# EasyEDA Pro project ProProject_IMUSensorNodes202312.epro, board 6_6_拼板20240123（带编号） (continued)
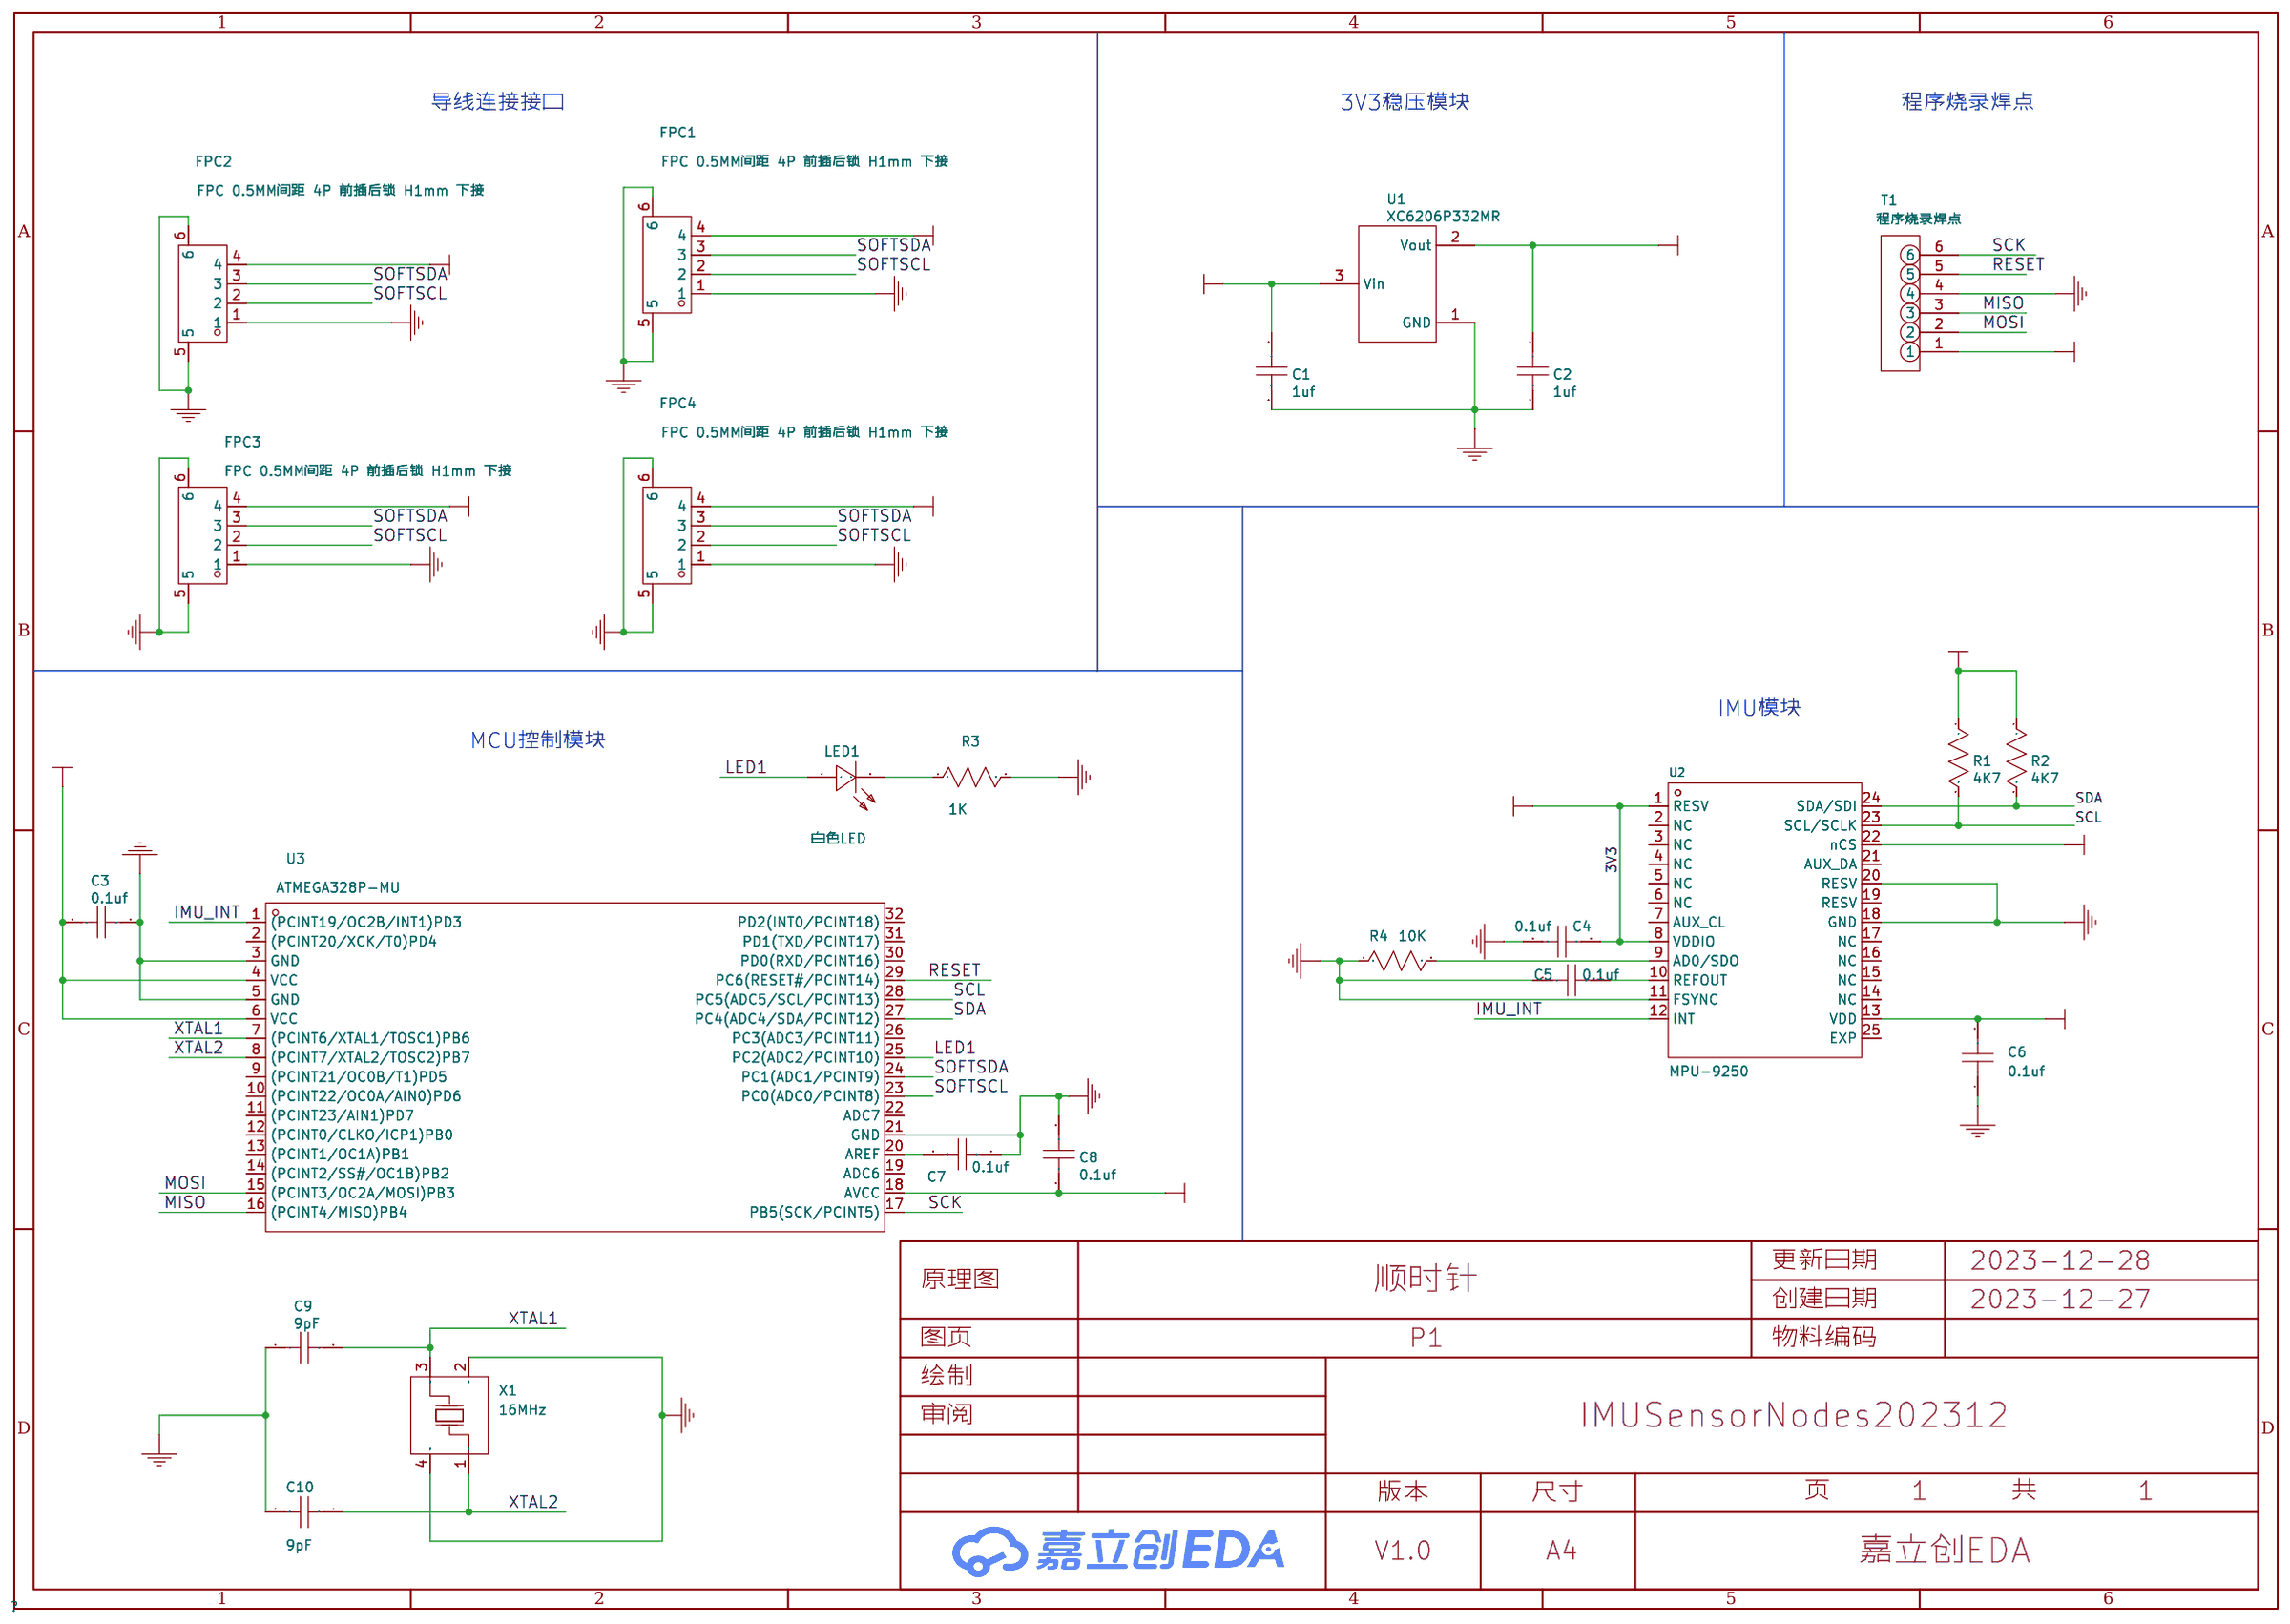
[diagram p0: schematic sheet]
## Routing (per net, layer and track width the routed paths; a pad name or vN(x,y) marks a point on that pad's centre or on a via; arc(x,y) is an arc through that point) (continued)
  Bottom Layer w0.254: 16.46,51.58 16.27,51.58 16.16,51.46 14.64,51.46 14.25,51.08 14.25,45.11 15,44.36 Designator#902.27 ; 16.46,51.58 Designator#418.2 ; 16.46,51.58 Designator#890.24 ; 43.76,10.43 43.58,10.43 43.47,10.32 41.94,10.32 41.56,9.94 41.56,3.97 42.31,3.22 Designator#838.27 ; 43.76,10.43 Designator#326.24 ; 43.76,10.43 Designator#373.2 ; Designator#830.24 71.07,37.86 ; 71.07,37.86 70.88,37.86 70.77,37.75 69.25,37.75 68.87,37.37 68.87,31.4 69.62,30.65 Designator#801.27 ; 71.07,37.86 Designator#341.2 ; Designator#820.27 15,71.8 14.25,72.55 14.25,78.52 14.64,78.9 16.16,78.9 16.27,79.01 16.46,79.01 ; 43.76,24.14 43.58,24.14 43.47,24.03 41.94,24.03 41.56,23.65 41.56,17.68 42.31,16.93 Designator#885.27 ; 43.76,24.14 Designator#813.24 ; 43.76,24.14 Designator#356.2 ; Designator#322.27 42.31,44.36 41.56,45.11 41.56,51.08 41.94,51.46 43.47,51.46 43.58,51.58 43.76,51.58 ; Designator#323.24 16.46,10.43 ; 16.46,10.43 16.27,10.43 16.16,10.32 14.64,10.32 14.25,9.94 14.25,3.97 15,3.22 Designator#913.27 ; 16.46,10.43 Designator#367.2 ; 43.76,79.01 43.58,79.01 43.47,78.9 41.94,78.9 41.56,78.52 41.56,72.55 42.31,71.8 Designator#889.27 ; 43.76,79.01 Designator#394.2 ; 43.76,79.01 Designator#880.24 ; Designator#918.24 71.07,79.01 ; 71.07,79.01 70.88,79.01 70.77,78.9 69.25,78.9 68.87,78.52 68.87,72.55 69.62,71.8 Designator#810.27 ; 71.07,79.01 Designator#344.2 ; Designator#883.24 71.07,24.14 ; 71.07,24.14 70.88,24.14 70.77,24.03 69.25,24.03 68.87,23.65 68.87,17.68 69.62,16.93 Designator#895.27 ; 71.07,24.14 Designator#362.2 ; 16.46,79.01 Designator#886.24 ; 16.46,79.01 Designator#388.2 ; 16.46,37.86 16.27,37.86 16.16,37.75 14.64,37.75 14.25,37.37 14.25,31.4 15,30.65 Designator#822.27 ; 16.46,37.86 Designator#923.24 ; 16.46,37.86 Designator#329.2 ; 43.76,65.29 43.58,65.29 43.47,65.18 41.94,65.18 41.56,64.8 41.56,58.83 42.31,58.08 Designator#324.27 ; 43.76,65.29 Designator#314.24 ; 43.76,65.29 Designator#406.2 ; Designator#897.24 43.76,51.58 ; 43.76,51.58 Designator#424.2 ; 16.46,24.14 16.27,24.14 16.16,24.03 14.64,24.03 14.25,23.65 14.25,17.68 15,16.93 Designator#904.27 ; 16.46,24.14 Designator#836.24 ; 16.46,24.14 Designator#350.2 ; 71.07,51.58 70.88,51.58 70.77,51.46 69.25,51.46 68.87,51.08 68.87,45.11 69.62,44.36 Designator#906.27 ; 71.07,51.58 Designator#430.2 ; 71.07,51.58 Designator#912.24 ; Designator#835.27 15,58.08 14.25,58.83 14.25,64.8 14.64,65.18 16.16,65.18 16.27,65.29 16.46,65.29 ; 16.46,65.29 Designator#400.2 ; 16.46,65.29 Designator#915.24 ; 71.07,65.29 Designator#412.2 ; 71.07,65.29 Designator#881.24 ; 71.07,65.29 70.88,65.29 70.77,65.18 69.25,65.18 68.87,64.8 68.87,58.83 69.62,58.08 Designator#809.27 ; Designator#882.24 43.76,37.86 ; 43.76,37.86 Designator#335.2 ; 43.76,37.86 43.58,37.86 43.47,37.75 41.94,37.75 41.56,37.37 41.56,31.4 42.31,30.65 Designator#839.27 ; Designator#826.24 71.07,10.43 ; 71.07,10.43 Designator#379.2 ; 71.07,10.43 70.88,10.43 70.77,10.32 69.25,10.32 68.87,9.94 68.87,3.97 69.62,3.22 Designator#910.27
SOFTSCL: length 811.1
  Top Layer w0.2: 61.88,64.93 61.81,64.99 58.52,64.99 58.2,64.67 58.2,63.78 56.55,62.13 56.55,61.24 57.18,60.61 Designator#241.3 ; Designator#214.2 19.97,50.55 19.43,51.08 18.57,51.08 17.94,50.45 17.94,47.65 17.68,47.4 16.92,47.4 Designator#283.2 ; 34.57,23.78 34.51,23.84 31.21,23.84 30.89,23.52 30.89,22.64 29.24,20.98 29.24,20.09 29.87,19.46 Designator#284.3 ; Designator#237.2 71.53,61.12 72.29,61.12 72.55,61.37 72.55,64.16 73.18,64.8 74.04,64.8 74.58,64.26 Designator#239.2 ; 61.88,51.21 61.81,51.28 58.52,51.28 58.2,50.96 58.2,50.07 56.55,48.42 56.55,47.53 57.18,46.9 Designator#164.3 ; 7.27,64.93 7.2,64.99 3.91,64.99 3.59,64.67 3.59,63.78 1.94,62.13 1.94,61.24 2.57,60.61 Designator#100.3 ; Designator#167.3 29.87,60.61 29.24,61.24 29.24,62.13 30.89,63.78 30.89,64.67 31.21,64.99 34.51,64.99 34.57,64.93 ; Designator#156.2 16.92,6.25 17.68,6.25 17.94,6.51 17.94,9.3 18.57,9.94 19.43,9.94 19.97,9.4 Designator#301.2 ; 34.57,51.21 34.51,51.28 31.21,51.28 30.89,50.96 30.89,50.07 29.24,48.42 29.24,47.53 29.87,46.9 Designator#173.3 ; Designator#2.3 2.57,19.46 1.94,20.09 1.94,20.98 3.59,22.64 3.59,23.52 3.91,23.84 7.2,23.84 7.27,23.78 ; Designator#282.3 2.57,46.9 1.94,47.53 1.94,48.42 3.59,50.07 3.59,50.96 3.91,51.28 7.2,51.28 7.27,51.21 ; Designator#217.2 71.53,19.97 72.29,19.97 72.55,20.22 72.55,23.02 73.18,23.65 74.04,23.65 74.58,23.11 Designator#238.2 ; Designator#221.2 47.27,23.11 46.73,23.65 45.88,23.65 45.24,23.02 45.24,20.22 44.99,19.97 44.22,19.97 Designator#312.2 ; Designator#98.2 71.53,6.25 72.29,6.25 72.55,6.51 72.55,9.3 73.18,9.94 74.04,9.94 74.58,9.4 Designator#6.2 ; 34.57,37.49 34.51,37.56 31.21,37.56 30.89,37.24 30.89,36.35 29.24,34.7 29.24,33.81 29.87,33.18 Designator#158.3 ; Designator#87.3 57.18,33.18 56.55,33.81 56.55,34.7 58.2,36.35 58.2,37.24 58.52,37.56 61.81,37.56 61.88,37.49 ; Designator#15.2 19.97,36.83 19.43,37.37 18.57,37.37 17.94,36.73 17.94,33.94 17.68,33.68 16.92,33.68 Designator#94.2 ; 34.57,78.64 34.51,78.71 31.21,78.71 30.89,78.39 30.89,77.5 29.24,75.85 29.24,74.96 29.87,74.33 Designator#220.3 ; Designator#225.2 19.97,64.26 19.43,64.8 18.57,64.8 17.94,64.16 17.94,61.37 17.68,61.12 16.92,61.12 Designator#3.2 ; Designator#168.3 29.87,5.75 29.24,6.38 29.24,7.27 30.89,8.92 30.89,9.81 31.21,10.13 34.51,10.13 34.57,10.06 ; Designator#18.2 74.58,77.98 74.04,78.52 73.18,78.52 72.55,77.88 72.55,75.09 72.29,74.83 71.53,74.83 Designator#92.2 ; Designator#219.2 44.22,33.68 44.99,33.68 45.24,33.94 45.24,36.73 45.88,37.37 46.73,37.37 47.27,36.83 Designator#218.2 ; Designator#81.3 2.57,5.75 1.94,6.38 1.94,7.27 3.59,8.92 3.59,9.81 3.91,10.13 7.2,10.13 7.27,10.06 ; 7.27,37.49 7.2,37.56 3.91,37.56 3.59,37.24 3.59,36.35 1.94,34.7 1.94,33.81 2.57,33.18 Designator#229.3 ; Designator#93.2 74.58,36.83 74.04,37.37 73.18,37.37 72.55,36.73 72.55,33.94 72.29,33.68 71.53,33.68 Designator#150.2 ; Designator#309.2 47.27,64.26 46.73,64.8 45.88,64.8 45.24,64.16 45.24,61.37 44.99,61.12 44.22,61.12 Designator#234.2 ; 61.88,78.64 61.81,78.71 58.52,78.71 58.2,78.39 58.2,77.5 56.55,75.85 56.55,74.96 57.18,74.33 Designator#9.3 ; Designator#289.3 2.57,74.33 1.94,74.96 1.94,75.85 3.59,77.5 3.59,78.39 3.91,78.71 7.2,78.71 7.27,78.64 ; 61.88,10.06 61.81,10.13 58.52,10.13 58.2,9.81 58.2,8.92 56.55,7.27 56.55,6.38 57.18,5.75 Designator#104.3 ; Designator#303.2 19.97,23.11 19.43,23.65 18.57,23.65 17.94,23.02 17.94,20.22 17.68,19.97 16.92,19.97 Designator#298.2 ; Designator#294.2 44.22,74.83 44.99,74.83 45.24,75.09 45.24,77.88 45.88,78.52 46.73,78.52 47.27,77.98 Designator#291.2 ; Designator#86.2 44.22,6.25 44.99,6.25 45.24,6.51 45.24,9.3 45.88,9.94 46.73,9.94 47.27,9.4 Designator#231.2 ; Designator#311.2 74.58,50.55 74.04,51.08 73.18,51.08 72.55,50.45 72.55,47.65 72.29,47.4 71.53,47.4 Designator#292.2 ; Designator#302.2 19.97,77.98 19.43,78.52 18.57,78.52 17.94,77.88 17.94,75.09 17.68,74.83 16.92,74.83 Designator#290.2 ; Designator#233.2 44.22,47.4 44.99,47.4 45.24,47.65 45.24,50.45 45.88,51.08 46.73,51.08 47.27,50.55 Designator#230.2 ; Designator#106.3 57.18,19.46 56.55,20.09 56.55,20.98 58.2,22.64 58.2,23.52 58.52,23.84 61.81,23.84 61.88,23.78
  Top Layer w0.254: Designator#227.3 60.86,72.54 61.09,72.77 64.18,72.77 64.85,73.44 64.85,74.22 64.24,74.83 Designator#165.3 62.77,74.83 62.39,75.21 62.39,78.13 61.88,78.64 60.86,78.64 ; Designator#149.3 33.55,3.96 33.79,4.19 36.88,4.19 37.54,4.86 37.54,5.63 36.93,6.25 Designator#244.3 35.47,6.25 35.08,6.63 35.08,9.55 34.57,10.06 33.56,10.06 ; Designator#238.2 74.58,21.89 74.84,21.62 78.01,21.62 78.64,20.98 78.64,19.84 78.27,19.46 Designator#157.2 76.36,19.46 75.89,18.99 75.89,16.08 75.49,15.68 75.37,15.68 75.34,15.65 74.71,15.65 74.08,16.29 Designator#222.2 ; Designator#93.2 74.58,35.6 74.84,35.33 78.01,35.33 78.64,34.7 78.64,33.56 78.27,33.18 Designator#243.2 76.36,33.18 75.89,32.71 75.89,29.79 75.49,29.39 75.37,29.39 75.34,29.37 74.71,29.37 74.08,30 Designator#96.2 ; Designator#231.2 47.27,8.17 47.54,7.9 50.7,7.9 51.34,7.27 51.34,6.12 50.96,5.75 Designator#159.2 49.06,5.75 48.59,5.28 48.59,2.36 48.18,1.96 48.06,1.96 48.04,1.93 47.41,1.93 46.77,2.57 Designator#163.2 ; 60.86,64.93 61.88,64.93 62.39,64.42 62.39,61.5 62.77,61.11 Designator#305.3 64.24,61.11 64.85,60.5 64.85,59.73 64.18,59.06 61.09,59.06 60.86,58.83 Designator#89.3 ; Designator#161.2 19.47,16.29 20.1,15.65 20.73,15.65 20.76,15.68 20.88,15.68 21.28,16.08 21.28,18.99 21.75,19.46 Designator#169.2 23.66,19.46 24.03,19.84 24.03,20.98 23.4,21.62 20.23,21.62 19.97,21.89 Designator#303.2 ; Designator#6.2 74.58,8.17 74.84,7.9 78.01,7.9 78.64,7.27 78.64,6.12 78.27,5.75 Designator#14.2 76.36,5.75 75.89,5.28 75.89,2.36 75.49,1.96 75.37,1.96 75.34,1.93 74.71,1.93 74.08,2.57 Designator#223.2 ; Designator#239.2 74.58,63.03 74.84,62.77 78.01,62.77 78.64,62.13 78.64,60.99 78.27,60.61 Designator#308.2 76.36,60.61 75.89,60.14 75.89,57.22 75.49,56.82 75.37,56.82 75.34,56.8 74.71,56.8 74.08,57.44 Designator#236.2 ; Designator#295.3 6.25,45.11 6.48,45.34 9.57,45.34 10.24,46.01 10.24,46.78 9.63,47.4 Designator#83.3 8.16,47.4 7.78,47.78 7.78,50.7 7.27,51.21 6.25,51.21 ; Designator#285.3 33.55,45.11 33.79,45.34 36.88,45.34 37.54,46.01 37.54,46.78 36.93,47.4 Designator#146.3 35.47,47.4 35.08,47.78 35.08,50.7 34.57,51.21 33.56,51.21 ; Designator#225.2 19.97,63.03 20.23,62.77 23.4,62.77 24.03,62.13 24.03,60.99 23.66,60.61 Designator#300.2 21.75,60.61 21.28,60.14 21.28,57.22 20.88,56.82 20.76,56.82 20.73,56.8 20.1,56.8 19.47,57.44 Designator#7.2 ; Designator#242.3 6.25,31.39 6.48,31.63 9.57,31.63 10.24,32.29 10.24,33.07 9.63,33.68 Designator#95.3 8.16,33.68 7.78,34.06 7.78,36.99 7.27,37.49 6.25,37.49 ; Designator#291.2 47.27,76.75 47.54,76.48 50.7,76.48 51.34,75.85 51.34,74.7 50.96,74.33 Designator#166.2 49.06,74.33 48.59,73.86 48.59,70.94 48.18,70.54 48.06,70.54 48.04,70.51 47.41,70.51 46.77,71.15 Designator#8.2 ; 60.86,51.21 61.88,51.21 62.39,50.7 62.39,47.78 62.77,47.4 Designator#109.3 64.24,47.4 64.85,46.78 64.85,46.01 64.18,45.34 61.09,45.34 60.86,45.11 Designator#154.3 ; Designator#306.3 33.55,58.83 33.79,59.06 36.88,59.06 37.54,59.73 37.54,60.5 36.93,61.11 Designator#171.3 35.47,61.11 35.08,61.5 35.08,64.42 34.57,64.93 33.56,64.93 ; Designator#216.3 60.86,31.39 61.09,31.63 64.18,31.63 64.85,32.29 64.85,33.07 64.24,33.68 Designator#103.3 62.77,33.68 62.39,34.06 62.39,36.99 61.88,37.49 60.86,37.49 ; Designator#311.2 74.58,49.32 74.84,49.05 78.01,49.05 78.64,48.42 78.64,47.27 78.27,46.9 Designator#215.2 76.36,46.9 75.89,46.42 75.89,43.51 75.49,43.11 75.37,43.11 75.34,43.08 74.71,43.08 74.08,43.72 Designator#85.2 ; 60.86,10.06 61.88,10.06 62.39,9.55 62.39,6.63 62.77,6.25 Designator#97.3 64.24,6.25 64.85,5.63 64.85,4.86 64.18,4.19 61.09,4.19 60.86,3.96 Designator#90.3 ; 6.25,23.78 7.27,23.78 7.78,23.27 7.78,20.35 8.16,19.96 Designator#84.3 9.63,19.96 10.24,19.35 10.24,18.58 9.57,17.91 6.48,17.91 6.25,17.68 Designator#172.3 ; Designator#108.3 60.86,17.68 61.09,17.91 64.18,17.91 64.85,18.58 64.85,19.35 64.24,19.96 Designator#170.3 62.77,19.96 62.39,20.35 62.39,23.27 61.88,23.78 60.86,23.78 ; Designator#301.2 19.97,8.17 20.23,7.9 23.4,7.9 24.03,7.27 24.03,6.12 23.66,5.75 Designator#5.2 21.75,5.75 21.28,5.28 21.28,2.36 20.88,1.96 20.76,1.96 20.73,1.93 20.1,1.93 19.47,2.57 Designator#105.2 ; Designator#221.2 47.27,21.89 47.54,21.62 50.7,21.62 51.34,20.98 51.34,19.84 50.96,19.46 Designator#148.2 49.06,19.46 48.59,18.99 48.59,16.08 48.18,15.68 48.06,15.68 48.04,15.65 47.41,15.65 46.77,16.29 Designator#16.2 ; Designator#245.3 33.55,31.39 33.79,31.63 36.88,31.63 37.54,32.29 37.54,33.07 36.93,33.68 Designator#160.3 35.47,33.68 35.08,34.06 35.08,36.99 34.57,37.49 33.56,37.49 ; Designator#101.2 19.47,43.72 20.1,43.08 20.73,43.08 20.76,43.11 20.88,43.11 21.28,43.51 21.28,46.42 21.75,46.9 Designator#11.2 23.66,46.9 24.03,47.27 24.03,48.42 23.4,49.05 20.23,49.05 19.97,49.32 Designator#214.2 ; 6.25,78.64 7.27,78.64 7.78,78.13 7.78,75.21 8.16,74.83 Designator#232.3 9.63,74.83 10.24,74.22 10.24,73.44 9.57,72.77 6.48,72.77 6.25,72.54 Designator#177.3 ; Designator#88.2 74.08,71.15 74.71,70.51 75.34,70.51 75.37,70.54 75.49,70.54 75.89,70.94 75.89,73.86 76.36,74.33 Designator#299.2 78.27,74.33 78.64,74.7 78.64,75.85 78.01,76.48 74.84,76.48 74.58,76.75 Designator#18.2 ; Designator#302.2 19.97,76.75 20.23,76.48 23.4,76.48 24.03,75.85 24.03,74.7 23.66,74.33 Designator#151.2 21.75,74.33 21.28,73.86 21.28,70.94 20.88,70.54 20.76,70.54 20.73,70.51 20.1,70.51 19.47,71.15 Designator#293.2 ; Designator#10.2 19.47,30 20.1,29.37 20.73,29.37 20.76,29.39 20.88,29.39 21.28,29.79 21.28,32.71 21.75,33.18 Designator#99.2 23.66,33.18 24.03,33.56 24.03,34.7 23.4,35.33 20.23,35.33 19.97,35.6 Designator#15.2 ; Designator#224.2 46.77,43.72 47.41,43.08 48.04,43.08 48.06,43.11 48.18,43.11 48.59,43.51 48.59,46.42 49.06,46.9 Designator.2 50.96,46.9 51.34,47.27 51.34,48.42 50.7,49.05 47.54,49.05 47.27,49.32 Designator#230.2 ; Designator#309.2 47.27,63.03 47.54,62.77 50.7,62.77 51.34,62.13 51.34,60.99 50.96,60.61 Designator#297.2 49.06,60.61 48.59,60.14 48.59,57.22 48.18,56.82 48.06,56.82 48.04,56.8 47.41,56.8 46.77,57.44 Designator#240.2 ; Designator#218.2 47.27,35.6 47.54,35.33 50.7,35.33 51.34,34.7 51.34,33.56 50.96,33.18 Designator#175.2 49.06,33.18 48.59,32.71 48.59,29.79 48.18,29.39 48.06,29.39 48.04,29.37 47.41,29.37 46.77,30 Designator#107.2 ; 6.25,64.93 7.27,64.93 7.78,64.42 7.78,61.5 8.16,61.11 Designator#155.3 9.63,61.11 10.24,60.5 10.24,59.73 9.57,59.06 6.48,59.06 6.25,58.83 Designator#19.3 ; 33.56,23.78 34.57,23.78 35.08,23.27 35.08,20.35 35.47,19.96 Designator#13.3 36.93,19.96 37.54,19.35 37.54,18.58 36.88,17.91 33.79,17.91 33.55,17.68 Designator#174.3 ; 33.56,78.64 34.57,78.64 35.08,78.13 35.08,75.21 35.47,74.83 Designator#288.3 36.93,74.83 37.54,74.22 37.54,73.44 36.88,72.77 33.79,72.77 33.55,72.54 Designator#153.3 ; 6.25,10.06 7.27,10.06 7.78,9.55 7.78,6.63 8.16,6.25 Designator#287.3 9.63,6.25 10.24,5.63 10.24,4.86 9.57,4.19 6.48,4.19 6.25,3.96 Designator#102.3
  vias: v1(3.33,70.26) v1(3.33,56.54) v1(3.33,42.83) v1(3.33,29.11) v1(3.33,15.4) v1(3.33,1.68) v1(17.05,69.88) v1(17.05,56.16) v1(17.05,42.45) v1(17.05,28.73) v1(17.05,15.01) v1(17.05,1.3) v1(30.64,70.26) v1(30.64,56.54) v1(30.64,42.83) v1(30.64,29.11) v1(30.64,15.4) v1(30.64,1.68) v1(44.35,69.88) v1(44.35,56.16) v1(44.35,42.45) v1(44.35,28.73) v1(44.35,15.01) v1(44.35,1.3) v1(57.94,70.26) v1(57.94,56.54) v1(57.94,42.83) v1(57.94,29.11) v1(57.94,15.4) v1(57.94,1.68) v1(71.66,69.88) v1(71.66,56.16) v1(71.66,42.45) v1(71.66,28.73) v1(71.66,15.01) v1(71.66,1.3)
SOFTSDA: length 633.1
  Top Layer w0.2: Designator#237.3 72.43,60.61 72.93,61.12 72.93,64.04 73.31,64.42 73.92,64.42 74.08,64.26 Designator#239.3 ; Designator#225.3 19.47,64.26 19.31,64.42 18.7,64.42 18.32,64.04 18.32,61.12 17.82,60.61 Designator#3.3 ; Designator#86.3 45.12,5.75 45.62,6.25 45.62,9.17 46,9.55 46.62,9.55 46.77,9.4 Designator#231.3 ; Designator#94.3 17.82,33.18 18.32,33.68 18.32,36.61 18.7,36.99 19.31,36.99 19.47,36.83 Designator#15.3 ; Designator#147.2 60.86,35.59 60.61,35.33 57.69,35.33 56.93,34.57 56.93,33.94 57.18,33.68 Designator#87.2 ; Designator#298.3 17.82,19.46 18.32,19.97 18.32,22.89 18.7,23.27 19.31,23.27 19.47,23.11 Designator#303.3 ; Designator#304.2 33.56,49.3 33.31,49.05 30.38,49.05 29.62,48.29 29.62,47.65 29.88,47.4 Designator#173.2 ; Designator#98.3 72.43,5.75 72.93,6.25 72.93,9.17 73.31,9.55 73.92,9.55 74.08,9.4 Designator#6.3 ; Designator#301.3 19.47,9.4 19.31,9.55 18.7,9.55 18.32,9.17 18.32,6.25 17.82,5.75 Designator#156.3 ; Designator#164.2 57.18,47.4 56.93,47.65 56.93,48.29 57.69,49.05 60.61,49.05 60.86,49.3 Designator#307.2 ; Designator#217.3 72.43,19.46 72.93,19.97 72.93,22.89 73.31,23.27 73.92,23.27 74.08,23.11 Designator#238.3 ; Designator#233.3 45.12,46.9 45.62,47.4 45.62,50.32 46,50.7 46.62,50.7 46.77,50.55 Designator#230.3 ; Designator#91.2 6.25,35.59 6,35.33 3.08,35.33 2.32,34.57 2.32,33.94 2.57,33.68 Designator#229.2 ; Designator#234.3 45.12,60.61 45.62,61.12 45.62,64.04 46,64.42 46.62,64.42 46.77,64.26 Designator#309.3 ; Designator#152.2 6.25,63.02 6,62.77 3.08,62.77 2.32,62 2.32,61.37 2.57,61.11 Designator#100.2 ; Designator#158.2 29.88,33.68 29.62,33.94 29.62,34.57 30.38,35.33 33.31,35.33 33.56,35.59 Designator#226.2 ; Designator#310.2 33.56,8.15 33.31,7.9 30.38,7.9 29.62,7.14 29.62,6.51 29.88,6.25 Designator#168.2 ; Designator#284.2 29.88,19.96 29.62,20.22 29.62,20.86 30.38,21.62 33.31,21.62 33.56,21.87 Designator#17.2 ; Designator#296.2 33.56,76.73 33.31,76.48 30.38,76.48 29.62,75.72 29.62,75.09 29.88,74.83 Designator#220.2 ; Designator#18.3 74.08,77.98 73.92,78.13 73.31,78.13 72.93,77.75 72.93,74.83 72.43,74.33 Designator#92.3 ; Designator#221.3 46.77,23.11 46.62,23.27 46,23.27 45.62,22.89 45.62,19.97 45.12,19.46 Designator#312.3 ; Designator#283.3 17.82,46.9 18.32,47.4 18.32,50.32 18.7,50.7 19.31,50.7 19.47,50.55 Designator#214.3 ; Designator#292.3 72.43,46.9 72.93,47.4 72.93,50.32 73.31,50.7 73.92,50.7 74.08,50.55 Designator#311.3 ; Designator#290.3 17.82,74.33 18.32,74.83 18.32,77.75 18.7,78.13 19.31,78.13 19.47,77.98 Designator#302.3 ; Designator#228.2 6.25,49.3 6,49.05 3.08,49.05 2.32,48.29 2.32,47.65 2.57,47.4 Designator#282.2 ; Designator#9.2 57.18,74.83 56.93,75.09 56.93,75.72 57.69,76.48 60.61,76.48 60.86,76.73 Designator#162.2 ; Designator#93.3 74.08,36.83 73.92,36.99 73.31,36.99 72.93,36.61 72.93,33.68 72.43,33.18 Designator#150.3 ; Designator#2.2 2.57,19.96 2.32,20.22 2.32,20.86 3.08,21.62 6,21.62 6.25,21.87 Designator#286.2 ; Designator#4.2 33.56,63.02 33.31,62.77 30.38,62.77 29.62,62 29.62,61.37 29.88,61.11 Designator#167.2 ; Designator#12.2 60.86,8.15 60.61,7.9 57.69,7.9 56.93,7.14 56.93,6.51 57.18,6.25 Designator#104.2 ; Designator#291.3 46.77,77.98 46.62,78.13 46,78.13 45.62,77.75 45.62,74.83 45.12,74.33 Designator#294.3 ; Designator#241.2 57.18,61.11 56.93,61.37 56.93,62 57.69,62.77 60.61,62.77 60.86,63.02 Designator#176.2 ; Designator#81.2 2.57,6.25 2.32,6.51 2.32,7.14 3.08,7.9 6,7.9 6.25,8.15 Designator#20.2 ; Designator#82.2 6.25,76.73 6,76.48 3.08,76.48 2.32,75.72 2.32,75.09 2.57,74.83 Designator#289.2 ; Designator#235.2 60.86,21.87 60.61,21.62 57.69,21.62 56.93,20.86 56.93,20.22 57.18,19.96 Designator#106.2 ; Designator#219.3 45.12,33.18 45.62,33.68 45.62,36.61 46,36.99 46.62,36.99 46.77,36.83 Designator#218.3
  Top Layer w0.254: Designator#146.2 35.21,46.9 34.96,47.15 34.7,47.15 34.57,47.27 34.57,50.58 34.32,50.83 33.81,50.83 33.56,50.57 Designator#304.2 ; 43.85,71.02 43.85,70.26 v1(43.47,69.88) ; 16.54,16.16 16.54,15.4 v1(16.16,15.01) ; Designator#225.3 19.47,62.89 19.97,62.39 23.15,62.39 23.65,61.88 23.65,61.37 23.39,61.11 Designator#300.3 21.36,61.11 20.92,60.67 20.92,57.37 20.73,57.18 20.35,57.18 19.97,57.56 Designator#7.3 ; v1(16.16,69.88) 16.54,70.26 16.54,71.02 ; Designator#232.2 7.9,74.33 7.65,74.58 7.4,74.58 7.27,74.7 7.27,78.01 7.02,78.26 6.51,78.26 6.25,78 Designator#82.2 ; 16.54,2.44 16.54,1.68 v1(16.16,1.3) ; 71.15,16.16 71.15,15.4 v1(70.77,15.01) ; Designator#302.3 19.47,76.61 19.97,76.1 23.15,76.1 23.65,75.59 23.65,75.09 23.39,74.83 Designator#151.3 21.36,74.83 20.92,74.39 20.92,71.09 20.73,70.89 20.35,70.89 19.97,71.28 Designator#293.3 ; Designator#221.3 46.77,21.74 47.28,21.24 50.45,21.24 50.96,20.73 50.96,20.22 50.7,19.96 Designator#148.3 48.67,19.96 48.23,19.53 48.23,16.22 48.04,16.03 47.66,16.03 47.27,16.42 Designator#16.3 ; Designator#160.2 35.21,33.18 34.96,33.43 34.7,33.43 34.57,33.56 34.57,36.86 34.32,37.11 33.81,37.11 33.56,36.86 Designator#226.2 ; Designator#12.2 60.86,9.43 61.12,9.68 61.63,9.68 61.88,9.43 61.88,6.12 62.01,6 62.26,6 62.51,5.75 Designator#97.2 ; Designator#101.3 19.97,43.85 20.35,43.46 20.73,43.46 20.92,43.66 20.92,46.96 21.36,47.4 Designator#11.3 23.39,47.4 23.65,47.65 23.65,48.16 23.15,48.67 19.97,48.67 19.47,49.17 Designator#214.3 ; Designator#88.3 74.58,71.28 74.96,70.89 75.34,70.89 75.53,71.09 75.53,74.39 75.97,74.83 Designator#299.3 78,74.83 78.26,75.09 78.26,75.59 77.75,76.1 74.58,76.1 74.08,76.61 Designator#18.3 ; 71.15,2.44 71.15,1.68 v1(70.77,1.3) ; 71.15,29.87 71.15,29.11 v1(70.77,28.73) ; v1(16.16,28.73) 16.54,29.11 16.54,29.87 ; Designator#244.2 35.21,5.75 34.96,6 34.7,6 34.57,6.12 34.57,9.43 34.32,9.68 33.81,9.68 33.56,9.43 Designator#310.2 ; Designator#239.3 74.08,62.89 74.58,62.39 77.75,62.39 78.26,61.88 78.26,61.37 78,61.11 Designator#308.3 75.97,61.11 75.53,60.67 75.53,57.37 75.34,57.18 74.96,57.18 74.58,57.56 Designator#236.3 ; Designator#107.3 47.27,30.13 47.66,29.75 48.04,29.75 48.23,29.94 48.23,33.24 48.67,33.68 Designator#175.3 50.7,33.68 50.96,33.94 50.96,34.45 50.45,34.95 47.28,34.95 46.77,35.46 Designator#218.3 ; Designator#17.2 33.56,23.14 33.81,23.4 34.32,23.4 34.57,23.14 34.57,19.84 34.7,19.71 34.96,19.71 35.21,19.46 Designator#13.2 ; Designator#222.3 74.58,16.42 74.96,16.03 75.34,16.03 75.53,16.22 75.53,19.53 75.97,19.96 Designator#157.3 78,19.96 78.26,20.22 78.26,20.73 77.75,21.24 74.58,21.24 74.08,21.74 Designator#238.3 ; Designator#224.3 47.27,43.85 47.66,43.46 48.04,43.46 48.23,43.66 48.23,46.96 48.67,47.4 Designator.3 50.7,47.4 50.96,47.65 50.96,48.16 50.45,48.67 47.28,48.67 46.77,49.17 Designator#230.3 ; 43.85,16.16 43.85,15.4 v1(43.47,15.01) ; 43.85,43.59 43.85,42.83 v1(43.47,42.45) ; Designator#20.2 6.25,9.43 6.51,9.68 7.02,9.68 7.27,9.43 7.27,6.12 7.4,6 7.65,6 7.9,5.75 Designator#287.2 ; Designator#96.3 74.58,30.13 74.96,29.75 75.34,29.75 75.53,29.94 75.53,33.24 75.97,33.68 Designator#243.3 78,33.68 78.26,33.94 78.26,34.45 77.75,34.95 74.58,34.95 74.08,35.46 Designator#93.3 ; Designator#10.3 19.97,30.13 20.35,29.75 20.73,29.75 20.92,29.94 20.92,33.24 21.36,33.68 Designator#99.3 23.39,33.68 23.65,33.94 23.65,34.45 23.15,34.95 19.97,34.95 19.47,35.46 Designator#15.3 ; Designator#235.2 60.86,23.14 61.12,23.4 61.63,23.4 61.88,23.14 61.88,19.84 62.01,19.71 62.26,19.71 62.51,19.46 Designator#170.2 ; Designator#288.2 35.21,74.33 34.96,74.58 34.7,74.58 34.57,74.7 34.57,78.01 34.32,78.26 33.81,78.26 33.56,78 Designator#296.2 ; v1(43.47,56.16) 43.85,56.54 43.85,57.31 ; Designator#286.2 6.25,23.14 6.51,23.4 7.02,23.4 7.27,23.14 7.27,19.84 7.4,19.71 7.65,19.71 7.9,19.46 Designator#84.2 ; Designator#83.2 7.9,46.9 7.65,47.15 7.4,47.15 7.27,47.27 7.27,50.58 7.02,50.83 6.51,50.83 6.25,50.57 Designator#228.2 ; v1(70.77,42.45) 71.15,42.83 71.15,43.59 ; Designator#162.2 60.86,78 61.12,78.26 61.63,78.26 61.88,78.01 61.88,74.7 62.01,74.58 62.26,74.58 62.51,74.33 Designator#165.2 ; 71.15,71.02 71.15,70.26 v1(70.77,69.88) ; Designator#8.3 47.27,71.28 47.66,70.89 48.04,70.89 48.23,71.09 48.23,74.39 48.67,74.83 Designator#166.3 50.7,74.83 50.96,75.09 50.96,75.59 50.45,76.1 47.28,76.1 46.77,76.61 Designator#291.3 ; v1(70.77,56.16) 71.15,56.54 71.15,57.31 ; 16.54,57.31 16.54,56.54 v1(16.16,56.16) ; Designator#109.2 62.51,46.9 62.26,47.15 62.01,47.15 61.88,47.27 61.88,50.58 61.63,50.83 61.12,50.83 60.86,50.57 Designator#307.2 ; 43.85,29.87 43.85,29.11 v1(43.47,28.73) ; Designator#223.3 74.58,2.7 74.96,2.31 75.34,2.31 75.53,2.51 75.53,5.81 75.97,6.25 Designator#14.3 78,6.25 78.26,6.51 78.26,7.01 77.75,7.52 74.58,7.52 74.08,8.03 Designator#6.3 ; v1(43.47,1.3) 43.85,1.68 43.85,2.44 ; Designator#161.3 19.97,16.42 20.35,16.03 20.73,16.03 20.92,16.22 20.92,19.53 21.36,19.96 Designator#169.3 23.39,19.96 23.65,20.22 23.65,20.73 23.15,21.24 19.97,21.24 19.47,21.74 Designator#303.3 ; Designator#176.2 60.86,64.29 61.12,64.55 61.63,64.55 61.88,64.29 61.88,60.99 62.01,60.86 62.26,60.86 62.51,60.61 Designator#305.2 ; Designator#152.2 6.25,64.29 6.51,64.55 7.02,64.55 7.27,64.29 7.27,60.99 7.4,60.86 7.65,60.86 7.9,60.61 Designator#155.2 ; 16.54,43.59 16.54,42.83 v1(16.16,42.45) ; Designator#163.3 47.27,2.7 47.66,2.31 48.04,2.31 48.23,2.51 48.23,5.81 48.67,6.25 Designator#159.3 50.7,6.25 50.96,6.51 50.96,7.01 50.45,7.52 47.28,7.52 46.77,8.03 Designator#231.3 ; Designator#309.3 46.77,62.89 47.28,62.39 50.45,62.39 50.96,61.88 50.96,61.37 50.7,61.11 Designator#297.3 48.67,61.11 48.23,60.67 48.23,57.37 48.04,57.18 47.66,57.18 47.27,57.56 Designator#240.3 ; Designator#91.2 6.25,36.86 6.51,37.11 7.02,37.11 7.27,36.86 7.27,33.56 7.4,33.43 7.65,33.43 7.9,33.18 Designator#95.2 ; Designator#147.2 60.86,36.86 61.12,37.11 61.63,37.11 61.88,36.86 61.88,33.56 62.01,33.43 62.26,33.43 62.51,33.18 Designator#103.2 ; Designator#105.3 19.97,2.7 20.35,2.31 20.73,2.31 20.92,2.51 20.92,5.81 21.36,6.25 Designator#5.3 23.39,6.25 23.65,6.51 23.65,7.01 23.15,7.52 19.97,7.52 19.47,8.03 Designator#301.3 ; Designator#171.2 35.21,60.61 34.96,60.86 34.7,60.86 34.57,60.99 34.57,64.29 34.32,64.55 33.81,64.55 33.56,64.29 Designator#4.2 ; Designator#85.3 74.58,43.85 74.96,43.46 75.34,43.46 75.53,43.66 75.53,46.96 75.97,47.4 Designator#215.3 78,47.4 78.26,47.65 78.26,48.16 77.75,48.67 74.58,48.67 74.08,49.17 Designator#311.3
  vias: v1(2.44,69.75) v1(2.44,56.04) v1(2.44,42.32) v1(2.44,28.6) v1(2.44,14.89) v1(2.44,1.17) v1(29.75,69.75) v1(29.75,56.04) v1(29.75,42.32) v1(29.75,28.6) v1(29.75,14.89) v1(29.75,1.17) v1(57.05,69.75) v1(57.05,56.04) v1(57.05,42.32) v1(57.05,28.6) v1(57.05,14.89) v1(57.05,1.17)
